# Altium schematic sheet WordClock2.SchDoc
size E; SheetNumber: 1; SheetTotal: 1
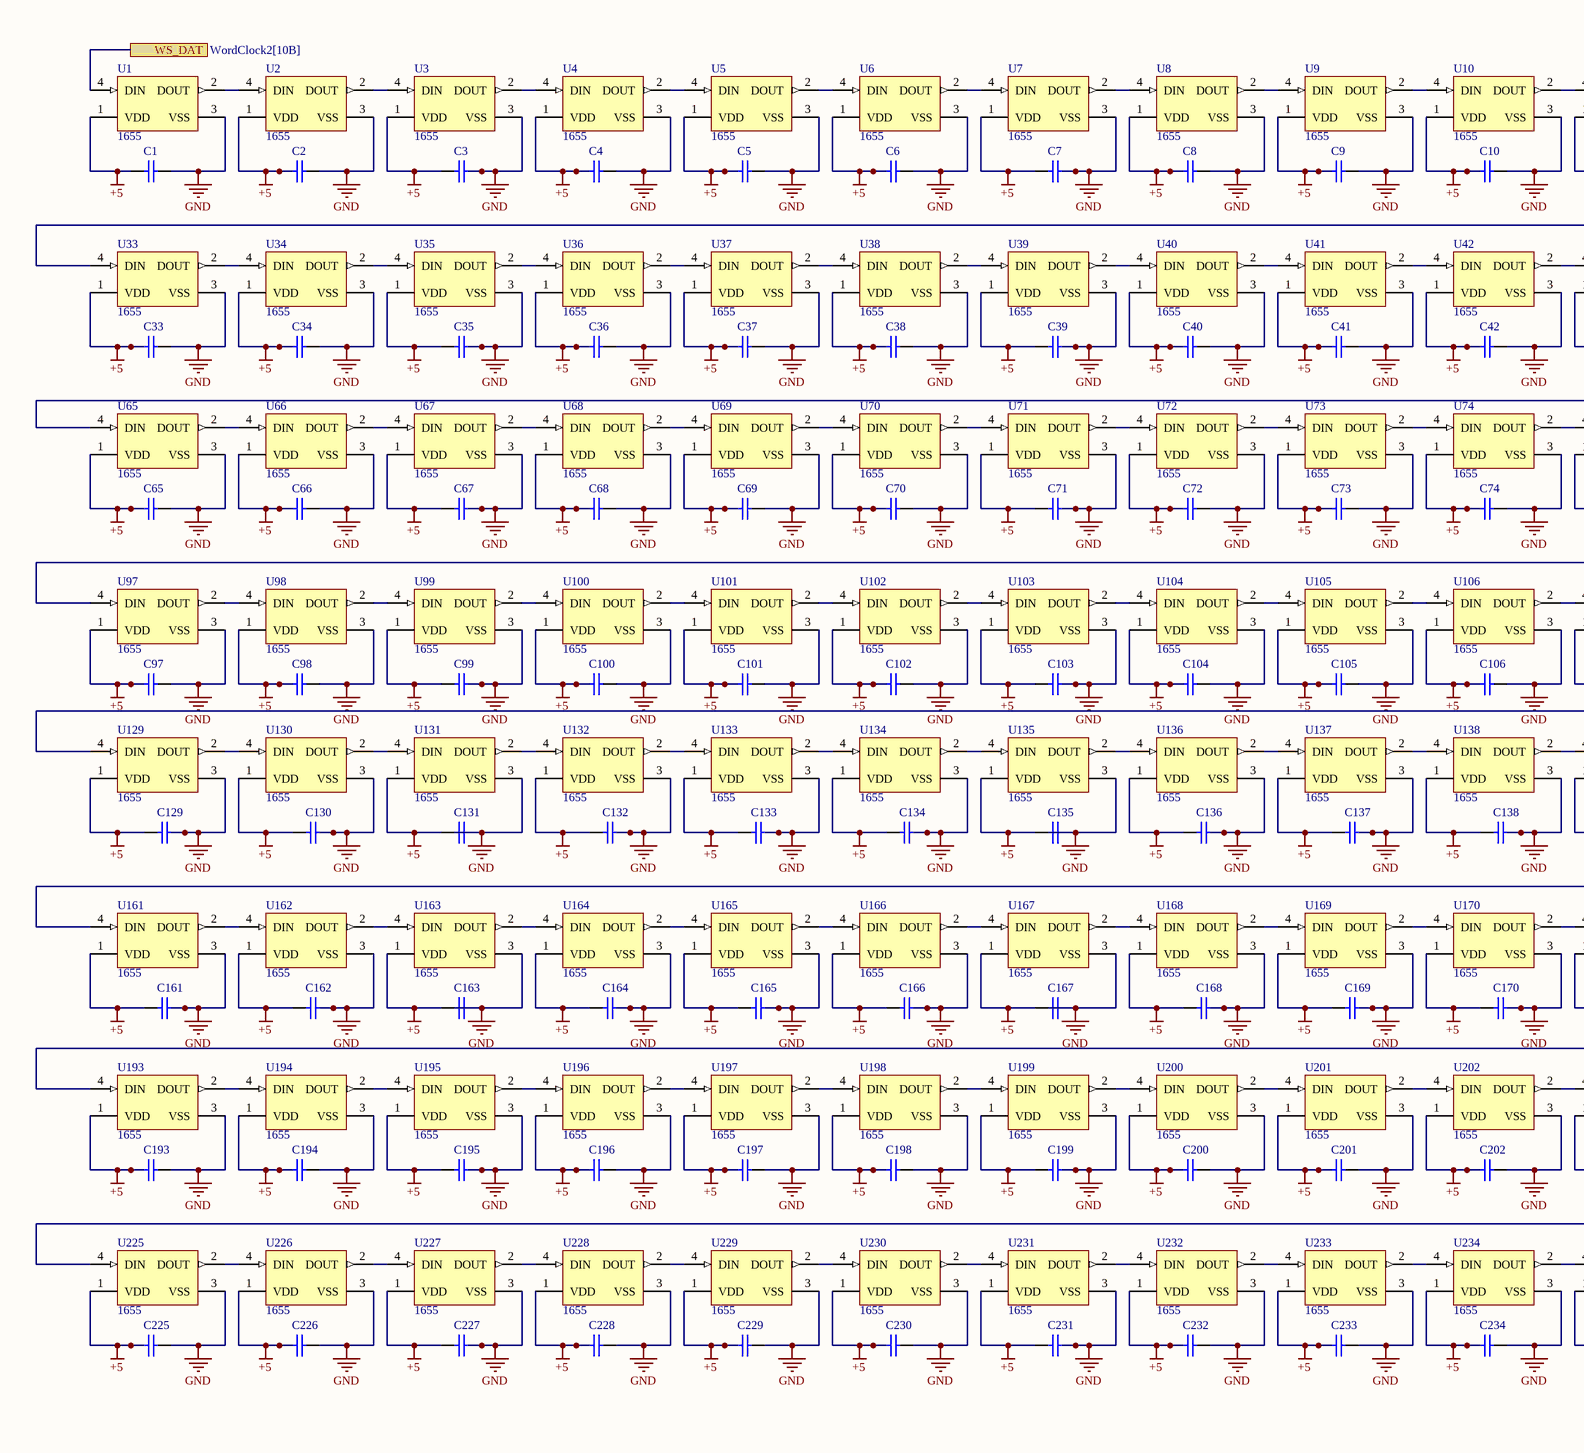
[diagram p0: WordClock2.SchDoc, left]
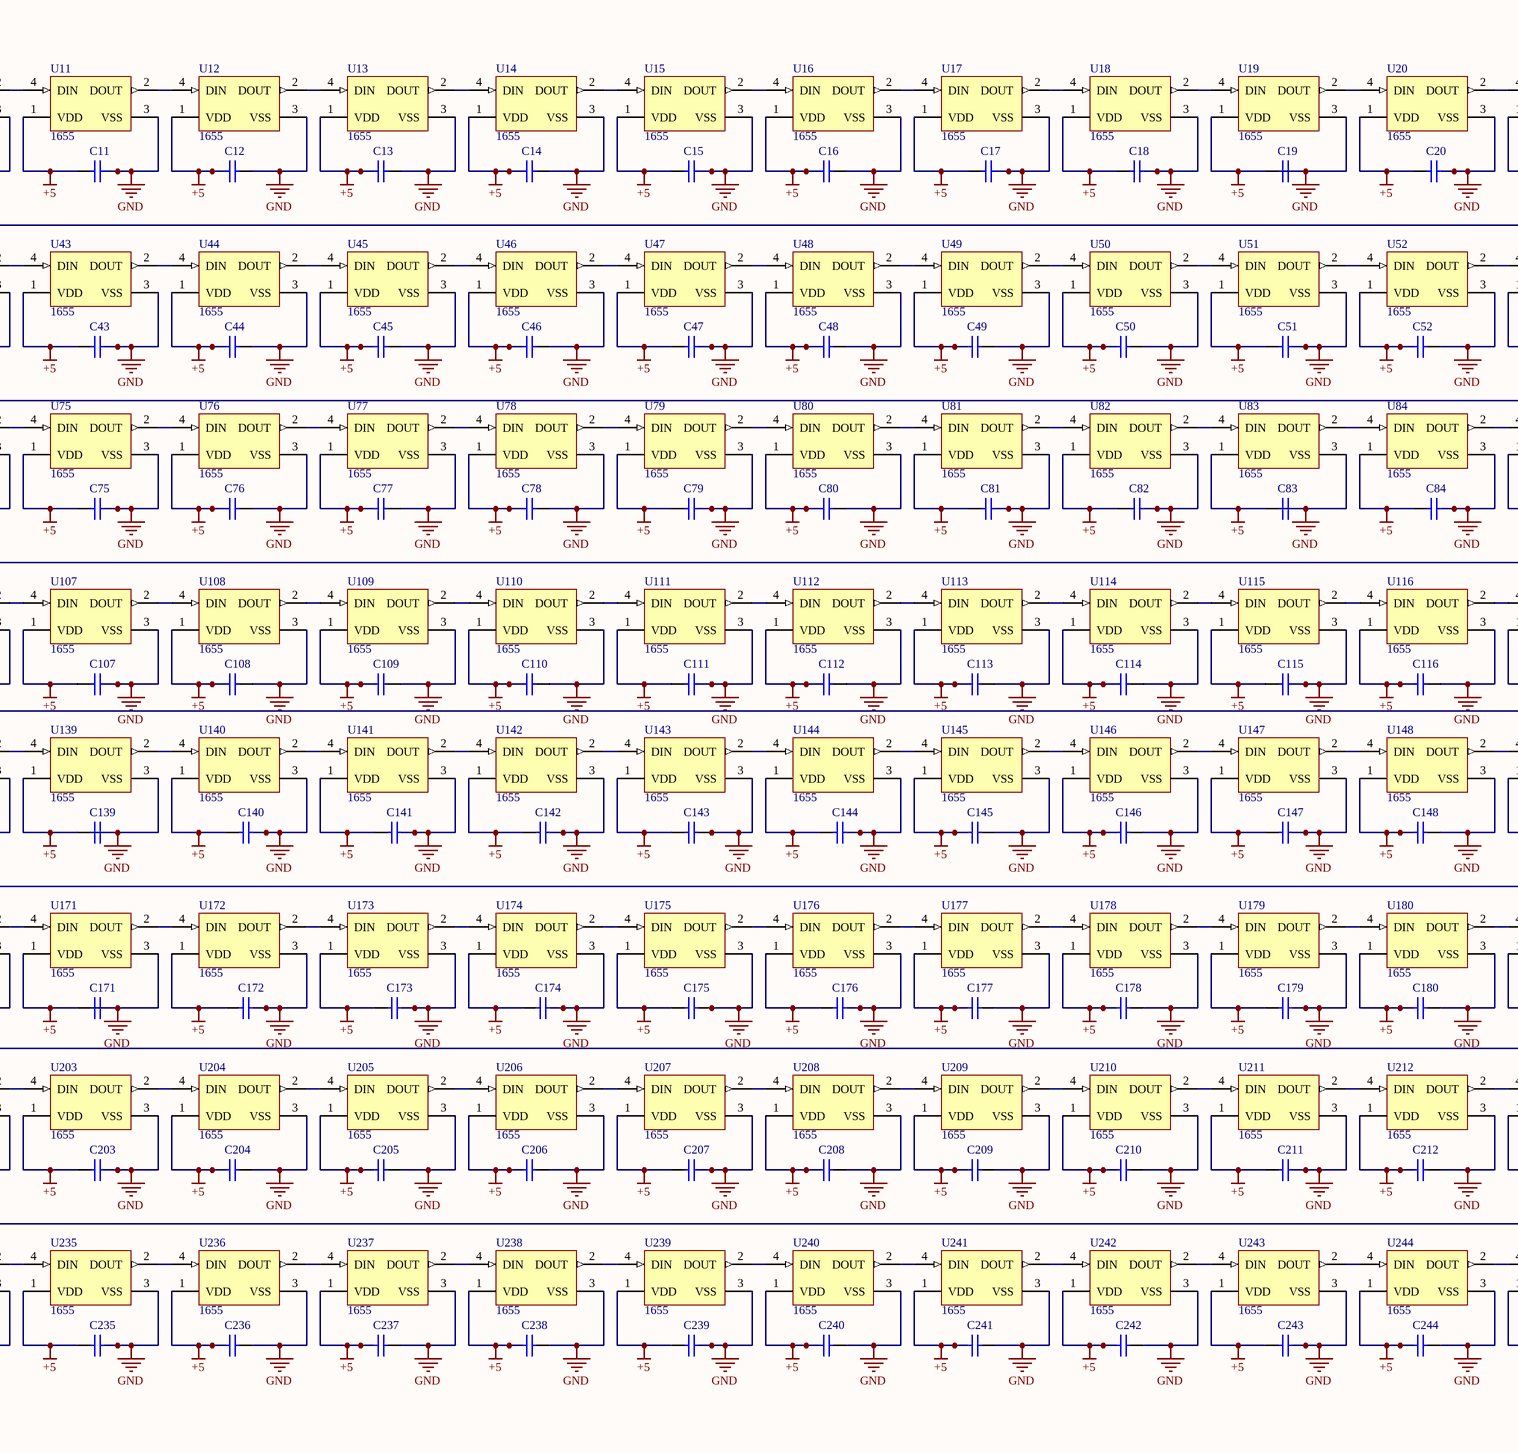
[diagram p1: WordClock2.SchDoc, middle]
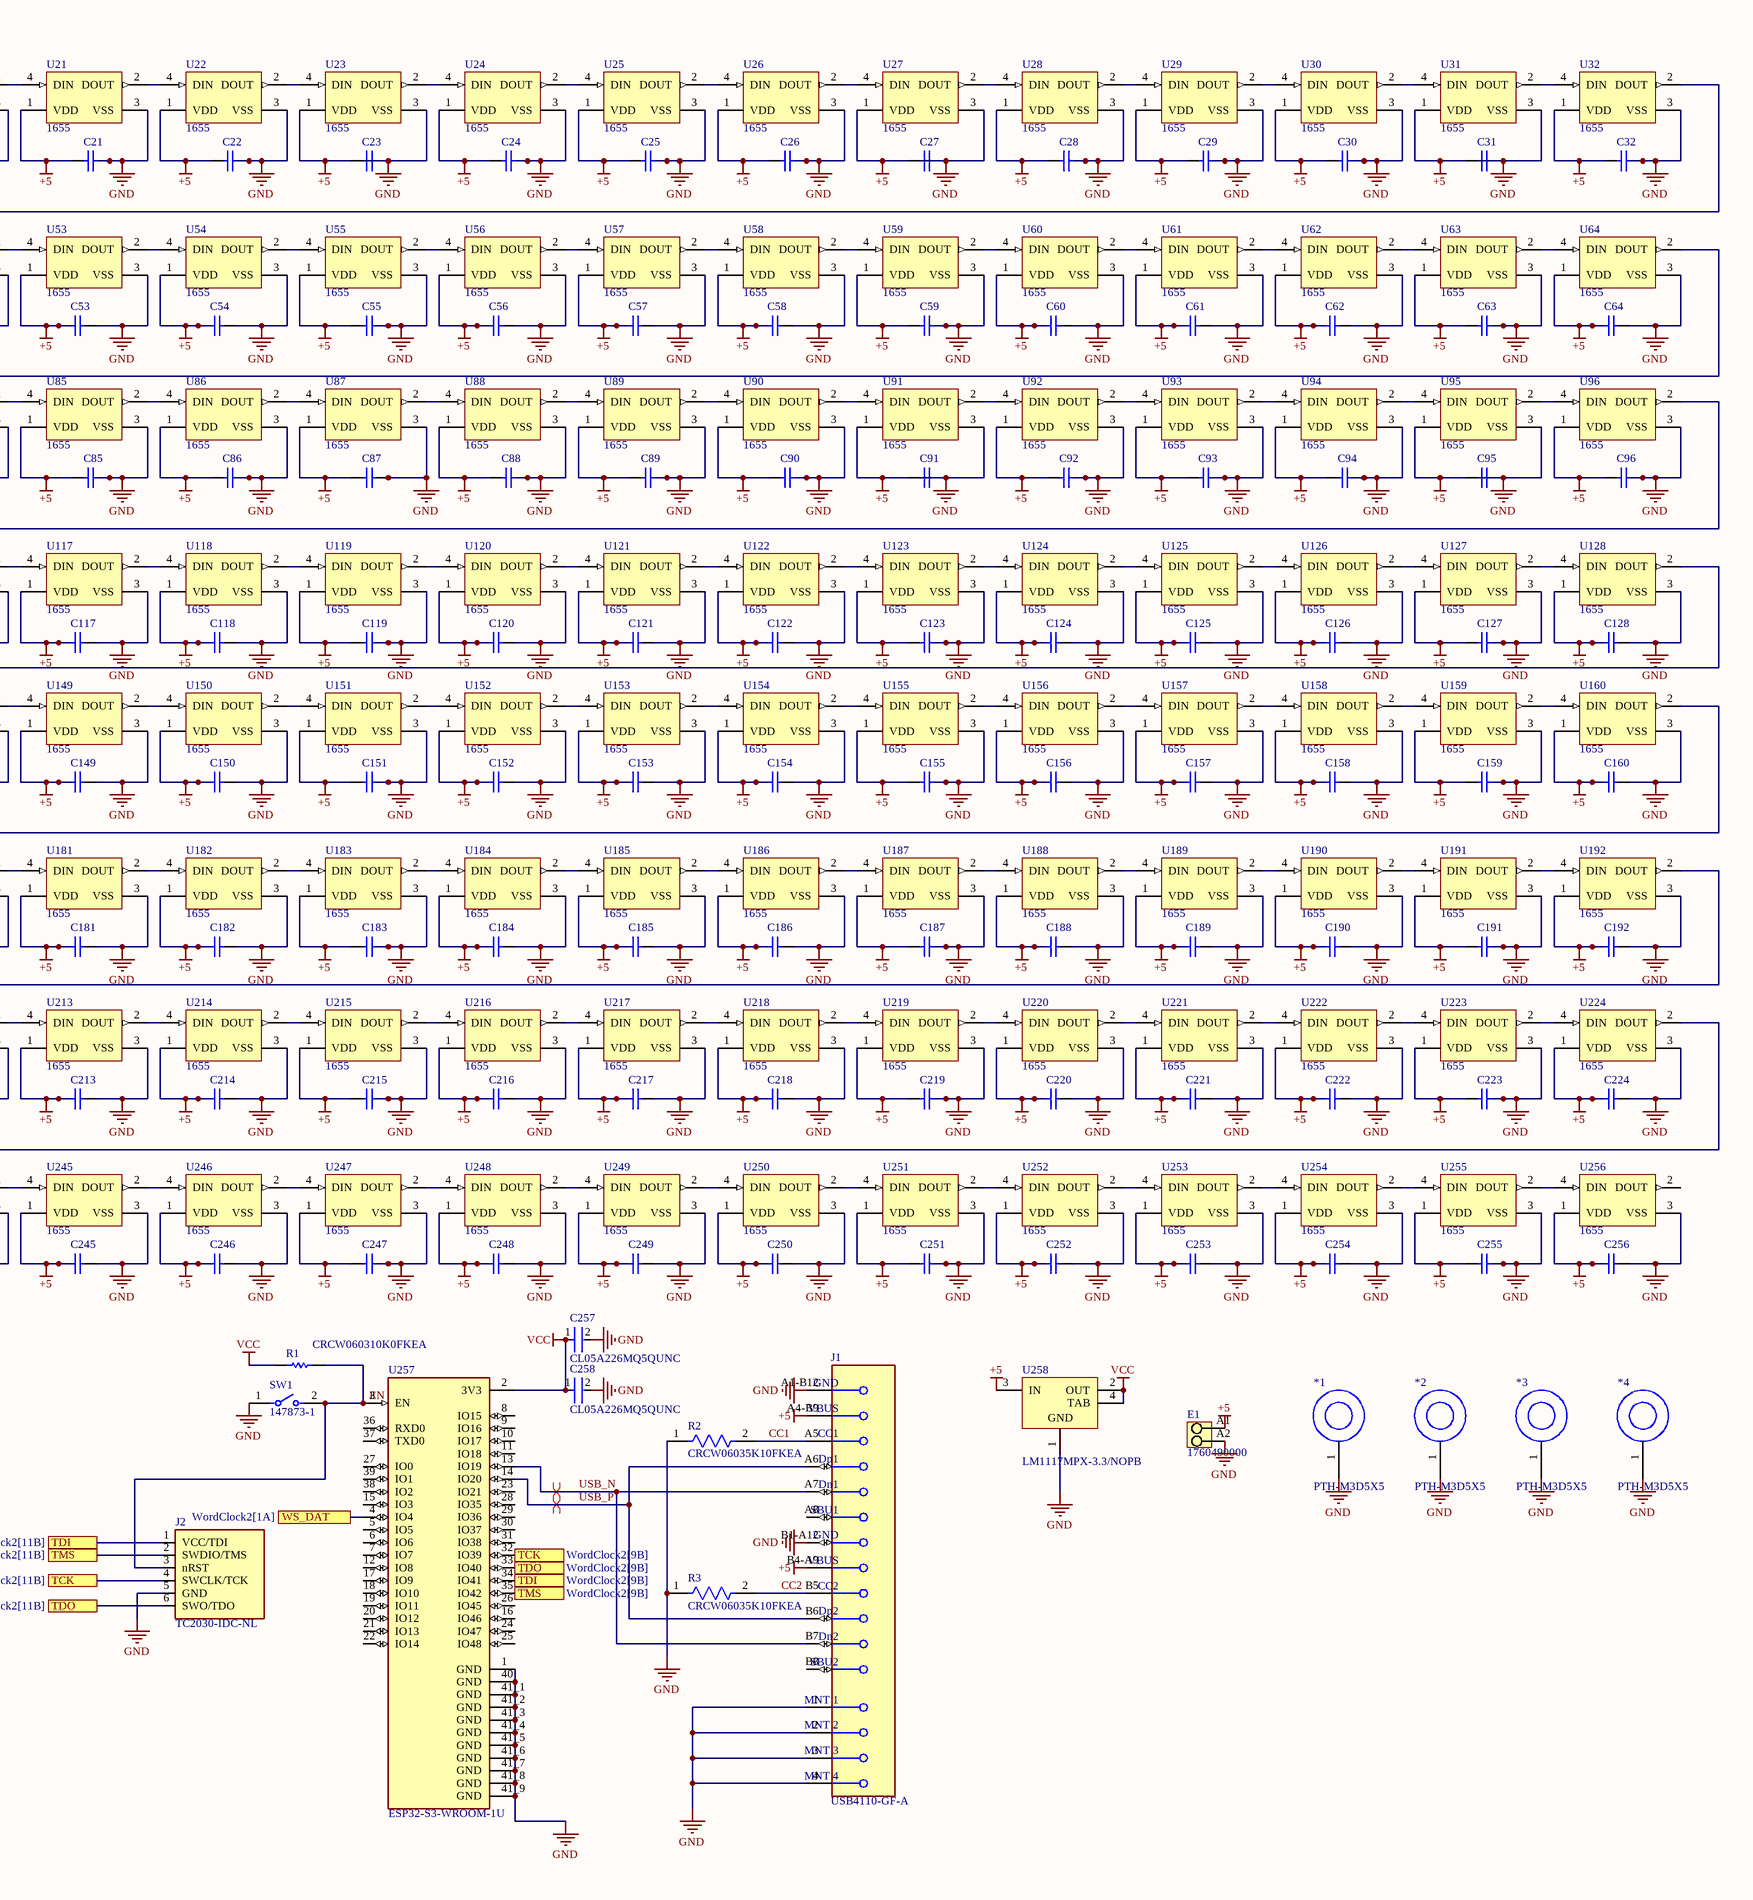
[diagram p2: WordClock2.SchDoc, right]

## Parts
*1  PTH-M3D5X5  [PTH-M3D5X5-Footprint-1]
*2  PTH-M3D5X5  [PTH-M3D5X5-Footprint-1]
*3  PTH-M3D5X5  [PTH-M3D5X5-Footprint-1]
*4  PTH-M3D5X5  [PTH-M3D5X5-Footprint-1]
C1  GRM188R71H104KA93D  [CAPC1608X90X35ML10T15]  (value not drawn)
C2  GRM188R71H104KA93D  [CAPC1608X90X35ML10T15]  (value not drawn)
C3  GRM188R71H104KA93D  [CAPC1608X90X35ML10T15]  (value not drawn)
C4  GRM188R71H104KA93D  [CAPC1608X90X35ML10T15]  (value not drawn)
C5  GRM188R71H104KA93D  [CAPC1608X90X35ML10T15]  (value not drawn)
C6  GRM188R71H104KA93D  [CAPC1608X90X35ML10T15]  (value not drawn)
C7  GRM188R71H104KA93D  [CAPC1608X90X35ML10T15]  (value not drawn)
C8  GRM188R71H104KA93D  [CAPC1608X90X35ML10T15]  (value not drawn)
C9  GRM188R71H104KA93D  [CAPC1608X90X35ML10T15]  (value not drawn)
C10  GRM188R71H104KA93D  [CAPC1608X90X35ML10T15]  (value not drawn)
C11  GRM188R71H104KA93D  [CAPC1608X90X35ML10T15]  (value not drawn)
C12  GRM188R71H104KA93D  [CAPC1608X90X35ML10T15]  (value not drawn)
C13  GRM188R71H104KA93D  [CAPC1608X90X35ML10T15]  (value not drawn)
C14  GRM188R71H104KA93D  [CAPC1608X90X35ML10T15]  (value not drawn)
C15  GRM188R71H104KA93D  [CAPC1608X90X35ML10T15]  (value not drawn)
C16  GRM188R71H104KA93D  [CAPC1608X90X35ML10T15]  (value not drawn)
C17  GRM188R71H104KA93D  [CAPC1608X90X35ML10T15]  (value not drawn)
C18  GRM188R71H104KA93D  [CAPC1608X90X35ML10T15]  (value not drawn)
C19  GRM188R71H104KA93D  [CAPC1608X90X35ML10T15]  (value not drawn)
C20  GRM188R71H104KA93D  [CAPC1608X90X35ML10T15]  (value not drawn)
C21  GRM188R71H104KA93D  [CAPC1608X90X35ML10T15]  (value not drawn)
C22  GRM188R71H104KA93D  [CAPC1608X90X35ML10T15]  (value not drawn)
C23  GRM188R71H104KA93D  [CAPC1608X90X35ML10T15]  (value not drawn)
C24  GRM188R71H104KA93D  [CAPC1608X90X35ML10T15]  (value not drawn)
C25  GRM188R71H104KA93D  [CAPC1608X90X35ML10T15]  (value not drawn)
C26  GRM188R71H104KA93D  [CAPC1608X90X35ML10T15]  (value not drawn)
C27  GRM188R71H104KA93D  [CAPC1608X90X35ML10T15]  (value not drawn)
C28  GRM188R71H104KA93D  [CAPC1608X90X35ML10T15]  (value not drawn)
C29  GRM188R71H104KA93D  [CAPC1608X90X35ML10T15]  (value not drawn)
C30  GRM188R71H104KA93D  [CAPC1608X90X35ML10T15]  (value not drawn)
C31  GRM188R71H104KA93D  [CAPC1608X90X35ML10T15]  (value not drawn)
C32  GRM188R71H104KA93D  [CAPC1608X90X35ML10T15]  (value not drawn)
C33  GRM188R71H104KA93D  [CAPC1608X90X35ML10T15]  (value not drawn)
C34  GRM188R71H104KA93D  [CAPC1608X90X35ML10T15]  (value not drawn)
C35  GRM188R71H104KA93D  [CAPC1608X90X35ML10T15]  (value not drawn)
C36  GRM188R71H104KA93D  [CAPC1608X90X35ML10T15]  (value not drawn)
C37  GRM188R71H104KA93D  [CAPC1608X90X35ML10T15]  (value not drawn)
C38  GRM188R71H104KA93D  [CAPC1608X90X35ML10T15]  (value not drawn)
C39  GRM188R71H104KA93D  [CAPC1608X90X35ML10T15]  (value not drawn)
C40  GRM188R71H104KA93D  [CAPC1608X90X35ML10T15]  (value not drawn)
C41  GRM188R71H104KA93D  [CAPC1608X90X35ML10T15]  (value not drawn)
C42  GRM188R71H104KA93D  [CAPC1608X90X35ML10T15]  (value not drawn)
C43  GRM188R71H104KA93D  [CAPC1608X90X35ML10T15]  (value not drawn)
C44  GRM188R71H104KA93D  [CAPC1608X90X35ML10T15]  (value not drawn)
C45  GRM188R71H104KA93D  [CAPC1608X90X35ML10T15]  (value not drawn)
C46  GRM188R71H104KA93D  [CAPC1608X90X35ML10T15]  (value not drawn)
C47  GRM188R71H104KA93D  [CAPC1608X90X35ML10T15]  (value not drawn)
C48  GRM188R71H104KA93D  [CAPC1608X90X35ML10T15]  (value not drawn)
C49  GRM188R71H104KA93D  [CAPC1608X90X35ML10T15]  (value not drawn)
C50  GRM188R71H104KA93D  [CAPC1608X90X35ML10T15]  (value not drawn)
C51  GRM188R71H104KA93D  [CAPC1608X90X35ML10T15]  (value not drawn)
C52  GRM188R71H104KA93D  [CAPC1608X90X35ML10T15]  (value not drawn)
C53  GRM188R71H104KA93D  [CAPC1608X90X35ML10T15]  (value not drawn)
C54  GRM188R71H104KA93D  [CAPC1608X90X35ML10T15]  (value not drawn)
C55  GRM188R71H104KA93D  [CAPC1608X90X35ML10T15]  (value not drawn)
C56  GRM188R71H104KA93D  [CAPC1608X90X35ML10T15]  (value not drawn)
C57  GRM188R71H104KA93D  [CAPC1608X90X35ML10T15]  (value not drawn)
C58  GRM188R71H104KA93D  [CAPC1608X90X35ML10T15]  (value not drawn)
C59  GRM188R71H104KA93D  [CAPC1608X90X35ML10T15]  (value not drawn)
C60  GRM188R71H104KA93D  [CAPC1608X90X35ML10T15]  (value not drawn)
C61  GRM188R71H104KA93D  [CAPC1608X90X35ML10T15]  (value not drawn)
C62  GRM188R71H104KA93D  [CAPC1608X90X35ML10T15]  (value not drawn)
C63  GRM188R71H104KA93D  [CAPC1608X90X35ML10T15]  (value not drawn)
C64  GRM188R71H104KA93D  [CAPC1608X90X35ML10T15]  (value not drawn)
C65  GRM188R71H104KA93D  [CAPC1608X90X35ML10T15]  (value not drawn)
C66  GRM188R71H104KA93D  [CAPC1608X90X35ML10T15]  (value not drawn)
C67  GRM188R71H104KA93D  [CAPC1608X90X35ML10T15]  (value not drawn)
C68  GRM188R71H104KA93D  [CAPC1608X90X35ML10T15]  (value not drawn)
C69  GRM188R71H104KA93D  [CAPC1608X90X35ML10T15]  (value not drawn)
C70  GRM188R71H104KA93D  [CAPC1608X90X35ML10T15]  (value not drawn)
C71  GRM188R71H104KA93D  [CAPC1608X90X35ML10T15]  (value not drawn)
C72  GRM188R71H104KA93D  [CAPC1608X90X35ML10T15]  (value not drawn)
C73  GRM188R71H104KA93D  [CAPC1608X90X35ML10T15]  (value not drawn)
C74  GRM188R71H104KA93D  [CAPC1608X90X35ML10T15]  (value not drawn)
C75  GRM188R71H104KA93D  [CAPC1608X90X35ML10T15]  (value not drawn)
C76  GRM188R71H104KA93D  [CAPC1608X90X35ML10T15]  (value not drawn)
C77  GRM188R71H104KA93D  [CAPC1608X90X35ML10T15]  (value not drawn)
C78  GRM188R71H104KA93D  [CAPC1608X90X35ML10T15]  (value not drawn)
C79  GRM188R71H104KA93D  [CAPC1608X90X35ML10T15]  (value not drawn)
C80  GRM188R71H104KA93D  [CAPC1608X90X35ML10T15]  (value not drawn)
C81  GRM188R71H104KA93D  [CAPC1608X90X35ML10T15]  (value not drawn)
C82  GRM188R71H104KA93D  [CAPC1608X90X35ML10T15]  (value not drawn)
C83  GRM188R71H104KA93D  [CAPC1608X90X35ML10T15]  (value not drawn)
C84  GRM188R71H104KA93D  [CAPC1608X90X35ML10T15]  (value not drawn)
C85  GRM188R71H104KA93D  [CAPC1608X90X35ML10T15]  (value not drawn)
C86  GRM188R71H104KA93D  [CAPC1608X90X35ML10T15]  (value not drawn)
C87  GRM188R71H104KA93D  [CAPC1608X90X35ML10T15]  (value not drawn)
C88  GRM188R71H104KA93D  [CAPC1608X90X35ML10T15]  (value not drawn)
C89  GRM188R71H104KA93D  [CAPC1608X90X35ML10T15]  (value not drawn)
C90  GRM188R71H104KA93D  [CAPC1608X90X35ML10T15]  (value not drawn)
C91  GRM188R71H104KA93D  [CAPC1608X90X35ML10T15]  (value not drawn)
C92  GRM188R71H104KA93D  [CAPC1608X90X35ML10T15]  (value not drawn)
C93  GRM188R71H104KA93D  [CAPC1608X90X35ML10T15]  (value not drawn)
C94  GRM188R71H104KA93D  [CAPC1608X90X35ML10T15]  (value not drawn)
C95  GRM188R71H104KA93D  [CAPC1608X90X35ML10T15]  (value not drawn)
C96  GRM188R71H104KA93D  [CAPC1608X90X35ML10T15]  (value not drawn)
C97  GRM188R71H104KA93D  [CAPC1608X90X35ML10T15]  (value not drawn)
C98  GRM188R71H104KA93D  [CAPC1608X90X35ML10T15]  (value not drawn)
C99  GRM188R71H104KA93D  [CAPC1608X90X35ML10T15]  (value not drawn)
C100  GRM188R71H104KA93D  [CAPC1608X90X35ML10T15]  (value not drawn)
C101  GRM188R71H104KA93D  [CAPC1608X90X35ML10T15]  (value not drawn)
C102  GRM188R71H104KA93D  [CAPC1608X90X35ML10T15]  (value not drawn)
C103  GRM188R71H104KA93D  [CAPC1608X90X35ML10T15]  (value not drawn)
C104  GRM188R71H104KA93D  [CAPC1608X90X35ML10T15]  (value not drawn)
C105  GRM188R71H104KA93D  [CAPC1608X90X35ML10T15]  (value not drawn)
C106  GRM188R71H104KA93D  [CAPC1608X90X35ML10T15]  (value not drawn)
C107  GRM188R71H104KA93D  [CAPC1608X90X35ML10T15]  (value not drawn)
C108  GRM188R71H104KA93D  [CAPC1608X90X35ML10T15]  (value not drawn)
C109  GRM188R71H104KA93D  [CAPC1608X90X35ML10T15]  (value not drawn)
C110  GRM188R71H104KA93D  [CAPC1608X90X35ML10T15]  (value not drawn)
C111  GRM188R71H104KA93D  [CAPC1608X90X35ML10T15]  (value not drawn)
C112  GRM188R71H104KA93D  [CAPC1608X90X35ML10T15]  (value not drawn)
C113  GRM188R71H104KA93D  [CAPC1608X90X35ML10T15]  (value not drawn)
C114  GRM188R71H104KA93D  [CAPC1608X90X35ML10T15]  (value not drawn)
C115  GRM188R71H104KA93D  [CAPC1608X90X35ML10T15]  (value not drawn)
C116  GRM188R71H104KA93D  [CAPC1608X90X35ML10T15]  (value not drawn)
C117  GRM188R71H104KA93D  [CAPC1608X90X35ML10T15]  (value not drawn)
C118  GRM188R71H104KA93D  [CAPC1608X90X35ML10T15]  (value not drawn)
C119  GRM188R71H104KA93D  [CAPC1608X90X35ML10T15]  (value not drawn)
C120  GRM188R71H104KA93D  [CAPC1608X90X35ML10T15]  (value not drawn)
C121  GRM188R71H104KA93D  [CAPC1608X90X35ML10T15]  (value not drawn)
C122  GRM188R71H104KA93D  [CAPC1608X90X35ML10T15]  (value not drawn)
C123  GRM188R71H104KA93D  [CAPC1608X90X35ML10T15]  (value not drawn)
C124  GRM188R71H104KA93D  [CAPC1608X90X35ML10T15]  (value not drawn)
C125  GRM188R71H104KA93D  [CAPC1608X90X35ML10T15]  (value not drawn)
C126  GRM188R71H104KA93D  [CAPC1608X90X35ML10T15]  (value not drawn)
C127  GRM188R71H104KA93D  [CAPC1608X90X35ML10T15]  (value not drawn)
C128  GRM188R71H104KA93D  [CAPC1608X90X35ML10T15]  (value not drawn)
C129  GRM188R71H104KA93D  [CAPC1608X90X35ML10T15]  (value not drawn)
C130  GRM188R71H104KA93D  [CAPC1608X90X35ML10T15]  (value not drawn)
C131  GRM188R71H104KA93D  [CAPC1608X90X35ML10T15]  (value not drawn)
C132  GRM188R71H104KA93D  [CAPC1608X90X35ML10T15]  (value not drawn)
C133  GRM188R71H104KA93D  [CAPC1608X90X35ML10T15]  (value not drawn)
C134  GRM188R71H104KA93D  [CAPC1608X90X35ML10T15]  (value not drawn)
C135  GRM188R71H104KA93D  [CAPC1608X90X35ML10T15]  (value not drawn)
C136  GRM188R71H104KA93D  [CAPC1608X90X35ML10T15]  (value not drawn)
C137  GRM188R71H104KA93D  [CAPC1608X90X35ML10T15]  (value not drawn)
C138  GRM188R71H104KA93D  [CAPC1608X90X35ML10T15]  (value not drawn)
C139  GRM188R71H104KA93D  [CAPC1608X90X35ML10T15]  (value not drawn)
C140  GRM188R71H104KA93D  [CAPC1608X90X35ML10T15]  (value not drawn)
C141  GRM188R71H104KA93D  [CAPC1608X90X35ML10T15]  (value not drawn)
C142  GRM188R71H104KA93D  [CAPC1608X90X35ML10T15]  (value not drawn)
C143  GRM188R71H104KA93D  [CAPC1608X90X35ML10T15]  (value not drawn)
C144  GRM188R71H104KA93D  [CAPC1608X90X35ML10T15]  (value not drawn)
C145  GRM188R71H104KA93D  [CAPC1608X90X35ML10T15]  (value not drawn)
C146  GRM188R71H104KA93D  [CAPC1608X90X35ML10T15]  (value not drawn)
C147  GRM188R71H104KA93D  [CAPC1608X90X35ML10T15]  (value not drawn)
C148  GRM188R71H104KA93D  [CAPC1608X90X35ML10T15]  (value not drawn)
C149  GRM188R71H104KA93D  [CAPC1608X90X35ML10T15]  (value not drawn)
C150  GRM188R71H104KA93D  [CAPC1608X90X35ML10T15]  (value not drawn)
C151  GRM188R71H104KA93D  [CAPC1608X90X35ML10T15]  (value not drawn)
C152  GRM188R71H104KA93D  [CAPC1608X90X35ML10T15]  (value not drawn)
C153  GRM188R71H104KA93D  [CAPC1608X90X35ML10T15]  (value not drawn)
C154  GRM188R71H104KA93D  [CAPC1608X90X35ML10T15]  (value not drawn)
C155  GRM188R71H104KA93D  [CAPC1608X90X35ML10T15]  (value not drawn)
C156  GRM188R71H104KA93D  [CAPC1608X90X35ML10T15]  (value not drawn)
C157  GRM188R71H104KA93D  [CAPC1608X90X35ML10T15]  (value not drawn)
C158  GRM188R71H104KA93D  [CAPC1608X90X35ML10T15]  (value not drawn)
C159  GRM188R71H104KA93D  [CAPC1608X90X35ML10T15]  (value not drawn)
C160  GRM188R71H104KA93D  [CAPC1608X90X35ML10T15]  (value not drawn)
C161  GRM188R71H104KA93D  [CAPC1608X90X35ML10T15]  (value not drawn)
C162  GRM188R71H104KA93D  [CAPC1608X90X35ML10T15]  (value not drawn)
C163  GRM188R71H104KA93D  [CAPC1608X90X35ML10T15]  (value not drawn)
C164  GRM188R71H104KA93D  [CAPC1608X90X35ML10T15]  (value not drawn)
C165  GRM188R71H104KA93D  [CAPC1608X90X35ML10T15]  (value not drawn)
C166  GRM188R71H104KA93D  [CAPC1608X90X35ML10T15]  (value not drawn)
C167  GRM188R71H104KA93D  [CAPC1608X90X35ML10T15]  (value not drawn)
C168  GRM188R71H104KA93D  [CAPC1608X90X35ML10T15]  (value not drawn)
C169  GRM188R71H104KA93D  [CAPC1608X90X35ML10T15]  (value not drawn)
C170  GRM188R71H104KA93D  [CAPC1608X90X35ML10T15]  (value not drawn)
C171  GRM188R71H104KA93D  [CAPC1608X90X35ML10T15]  (value not drawn)
C172  GRM188R71H104KA93D  [CAPC1608X90X35ML10T15]  (value not drawn)
C173  GRM188R71H104KA93D  [CAPC1608X90X35ML10T15]  (value not drawn)
C174  GRM188R71H104KA93D  [CAPC1608X90X35ML10T15]  (value not drawn)
C175  GRM188R71H104KA93D  [CAPC1608X90X35ML10T15]  (value not drawn)
C176  GRM188R71H104KA93D  [CAPC1608X90X35ML10T15]  (value not drawn)
C177  GRM188R71H104KA93D  [CAPC1608X90X35ML10T15]  (value not drawn)
C178  GRM188R71H104KA93D  [CAPC1608X90X35ML10T15]  (value not drawn)
C179  GRM188R71H104KA93D  [CAPC1608X90X35ML10T15]  (value not drawn)
C180  GRM188R71H104KA93D  [CAPC1608X90X35ML10T15]  (value not drawn)
C181  GRM188R71H104KA93D  [CAPC1608X90X35ML10T15]  (value not drawn)
C182  GRM188R71H104KA93D  [CAPC1608X90X35ML10T15]  (value not drawn)
C183  GRM188R71H104KA93D  [CAPC1608X90X35ML10T15]  (value not drawn)
C184  GRM188R71H104KA93D  [CAPC1608X90X35ML10T15]  (value not drawn)
C185  GRM188R71H104KA93D  [CAPC1608X90X35ML10T15]  (value not drawn)
C186  GRM188R71H104KA93D  [CAPC1608X90X35ML10T15]  (value not drawn)
C187  GRM188R71H104KA93D  [CAPC1608X90X35ML10T15]  (value not drawn)
C188  GRM188R71H104KA93D  [CAPC1608X90X35ML10T15]  (value not drawn)
C189  GRM188R71H104KA93D  [CAPC1608X90X35ML10T15]  (value not drawn)
C190  GRM188R71H104KA93D  [CAPC1608X90X35ML10T15]  (value not drawn)
C191  GRM188R71H104KA93D  [CAPC1608X90X35ML10T15]  (value not drawn)
C192  GRM188R71H104KA93D  [CAPC1608X90X35ML10T15]  (value not drawn)
C193  GRM188R71H104KA93D  [CAPC1608X90X35ML10T15]  (value not drawn)
C194  GRM188R71H104KA93D  [CAPC1608X90X35ML10T15]  (value not drawn)
C195  GRM188R71H104KA93D  [CAPC1608X90X35ML10T15]  (value not drawn)
C196  GRM188R71H104KA93D  [CAPC1608X90X35ML10T15]  (value not drawn)
C197  GRM188R71H104KA93D  [CAPC1608X90X35ML10T15]  (value not drawn)
C198  GRM188R71H104KA93D  [CAPC1608X90X35ML10T15]  (value not drawn)
C199  GRM188R71H104KA93D  [CAPC1608X90X35ML10T15]  (value not drawn)
C200  GRM188R71H104KA93D  [CAPC1608X90X35ML10T15]  (value not drawn)
C201  GRM188R71H104KA93D  [CAPC1608X90X35ML10T15]  (value not drawn)
C202  GRM188R71H104KA93D  [CAPC1608X90X35ML10T15]  (value not drawn)
C203  GRM188R71H104KA93D  [CAPC1608X90X35ML10T15]  (value not drawn)
C204  GRM188R71H104KA93D  [CAPC1608X90X35ML10T15]  (value not drawn)
C205  GRM188R71H104KA93D  [CAPC1608X90X35ML10T15]  (value not drawn)
C206  GRM188R71H104KA93D  [CAPC1608X90X35ML10T15]  (value not drawn)
C207  GRM188R71H104KA93D  [CAPC1608X90X35ML10T15]  (value not drawn)
C208  GRM188R71H104KA93D  [CAPC1608X90X35ML10T15]  (value not drawn)
C209  GRM188R71H104KA93D  [CAPC1608X90X35ML10T15]  (value not drawn)
C210  GRM188R71H104KA93D  [CAPC1608X90X35ML10T15]  (value not drawn)
C211  GRM188R71H104KA93D  [CAPC1608X90X35ML10T15]  (value not drawn)
C212  GRM188R71H104KA93D  [CAPC1608X90X35ML10T15]  (value not drawn)
C213  GRM188R71H104KA93D  [CAPC1608X90X35ML10T15]  (value not drawn)
C214  GRM188R71H104KA93D  [CAPC1608X90X35ML10T15]  (value not drawn)
C215  GRM188R71H104KA93D  [CAPC1608X90X35ML10T15]  (value not drawn)
C216  GRM188R71H104KA93D  [CAPC1608X90X35ML10T15]  (value not drawn)
C217  GRM188R71H104KA93D  [CAPC1608X90X35ML10T15]  (value not drawn)
C218  GRM188R71H104KA93D  [CAPC1608X90X35ML10T15]  (value not drawn)
C219  GRM188R71H104KA93D  [CAPC1608X90X35ML10T15]  (value not drawn)
C220  GRM188R71H104KA93D  [CAPC1608X90X35ML10T15]  (value not drawn)
C221  GRM188R71H104KA93D  [CAPC1608X90X35ML10T15]  (value not drawn)
C222  GRM188R71H104KA93D  [CAPC1608X90X35ML10T15]  (value not drawn)
C223  GRM188R71H104KA93D  [CAPC1608X90X35ML10T15]  (value not drawn)
C224  GRM188R71H104KA93D  [CAPC1608X90X35ML10T15]  (value not drawn)
C225  GRM188R71H104KA93D  [CAPC1608X90X35ML10T15]  (value not drawn)
C226  GRM188R71H104KA93D  [CAPC1608X90X35ML10T15]  (value not drawn)
C227  GRM188R71H104KA93D  [CAPC1608X90X35ML10T15]  (value not drawn)
C228  GRM188R71H104KA93D  [CAPC1608X90X35ML10T15]  (value not drawn)
C229  GRM188R71H104KA93D  [CAPC1608X90X35ML10T15]  (value not drawn)
C230  GRM188R71H104KA93D  [CAPC1608X90X35ML10T15]  (value not drawn)
C231  GRM188R71H104KA93D  [CAPC1608X90X35ML10T15]  (value not drawn)
C232  GRM188R71H104KA93D  [CAPC1608X90X35ML10T15]  (value not drawn)
C233  GRM188R71H104KA93D  [CAPC1608X90X35ML10T15]  (value not drawn)
C234  GRM188R71H104KA93D  [CAPC1608X90X35ML10T15]  (value not drawn)
C235  GRM188R71H104KA93D  [CAPC1608X90X35ML10T15]  (value not drawn)
C236  GRM188R71H104KA93D  [CAPC1608X90X35ML10T15]  (value not drawn)
C237  GRM188R71H104KA93D  [CAPC1608X90X35ML10T15]  (value not drawn)
C238  GRM188R71H104KA93D  [CAPC1608X90X35ML10T15]  (value not drawn)
C239  GRM188R71H104KA93D  [CAPC1608X90X35ML10T15]  (value not drawn)